# EAGLE board Resistor_Resistor (EAGLE 8.3.0), part 8 of 32
## Placement (x,y rotation side) (continued)
R9178  10K  [0201]  80.21,109.17 0 top
R9179  10K  [0201]  80.21,109.78 0 top
R9180  10K  [0201]  80.21,110.39 0 top
R9181  10K  [0201]  80.21,111 0 top
R9182  10K  [0201]  80.21,111.61 0 top
R9183  10K  [0201]  80.21,112.22 0 top
R9184  10K  [0201]  80.21,112.83 0 top
R9185  10K  [0201]  80.21,113.44 0 top
R9186  10K  [0201]  80.21,114.05 0 top
R9187  10K  [0201]  80.21,114.66 0 top
R9188  10K  [0201]  80.21,115.27 0 top
R9189  10K  [0201]  80.21,115.87 0 top
R9190  10K  [0201]  80.21,116.48 0 top
R9191  10K  [0201]  80.21,117.09 0 top
R9192  10K  [0201]  80.21,117.7 0 top
R9193  10K  [0201]  80.21,118.31 0 top
R9194  10K  [0201]  80.21,118.92 0 top
R9195  10K  [0201]  80.21,119.53 0 top
R9196  10K  [0201]  80.21,120.14 0 top
R9197  10K  [0201]  80.21,120.75 0 top
R9198  10K  [0201]  80.21,121.36 0 top
R9199  10K  [0201]  80.21,121.97 0 top
R9200  10K  [0201]  80.21,122.58 0 top
R9201  10K  [0201]  81.43,1.27 0 top
R9202  10K  [0201]  81.43,1.88 0 top
R9203  10K  [0201]  81.43,2.49 0 top
R9204  10K  [0201]  81.43,3.1 0 top
R9205  10K  [0201]  81.43,3.71 0 top
R9206  10K  [0201]  81.43,4.32 0 top
R9207  10K  [0201]  81.43,4.93 0 top
R9208  10K  [0201]  81.43,5.54 0 top
R9209  10K  [0201]  81.43,6.15 0 top
R9210  10K  [0201]  81.43,6.76 0 top
R9211  10K  [0201]  81.43,7.37 0 top
R9212  10K  [0201]  81.43,7.98 0 top
R9213  10K  [0201]  81.43,8.59 0 top
R9214  10K  [0201]  81.43,9.19 0 top
R9215  10K  [0201]  81.43,9.8 0 top
R9216  10K  [0201]  81.43,10.41 0 top
R9217  10K  [0201]  81.43,11.02 0 top
R9218  10K  [0201]  81.43,11.63 0 top
R9219  10K  [0201]  81.43,12.24 0 top
R9220  10K  [0201]  81.43,12.85 0 top
R9221  10K  [0201]  81.43,13.46 0 top
R9222  10K  [0201]  81.43,14.07 0 top
R9223  10K  [0201]  81.43,14.68 0 top
R9224  10K  [0201]  81.43,15.29 0 top
R9225  10K  [0201]  81.43,15.9 0 top
R9226  10K  [0201]  81.43,16.51 0 top
R9227  10K  [0201]  81.43,17.12 0 top
R9228  10K  [0201]  81.43,17.73 0 top
R9229  10K  [0201]  81.43,18.34 0 top
R9230  10K  [0201]  81.43,18.95 0 top
R9231  10K  [0201]  81.43,19.56 0 top
R9232  10K  [0201]  81.43,20.17 0 top
R9233  10K  [0201]  81.43,20.78 0 top
R9234  10K  [0201]  81.43,21.39 0 top
R9235  10K  [0201]  81.43,22 0 top
R9236  10K  [0201]  81.43,22.61 0 top
R9237  10K  [0201]  81.43,23.22 0 top
R9238  10K  [0201]  81.43,23.83 0 top
R9239  10K  [0201]  81.43,24.43 0 top
R9240  10K  [0201]  81.43,25.04 0 top
R9241  10K  [0201]  81.43,25.65 0 top
R9242  10K  [0201]  81.43,26.26 0 top
R9243  10K  [0201]  81.43,26.87 0 top
R9244  10K  [0201]  81.43,27.48 0 top
R9245  10K  [0201]  81.43,28.09 0 top
R9246  10K  [0201]  81.43,28.7 0 top
R9247  10K  [0201]  81.43,29.31 0 top
R9248  10K  [0201]  81.43,29.92 0 top
R9249  10K  [0201]  81.43,30.53 0 top
R9250  10K  [0201]  81.43,31.14 0 top
R9251  10K  [0201]  81.43,31.75 0 top
R9252  10K  [0201]  81.43,32.36 0 top
R9253  10K  [0201]  81.43,32.97 0 top
R9254  10K  [0201]  81.43,33.58 0 top
R9255  10K  [0201]  81.43,34.19 0 top
R9256  10K  [0201]  81.43,34.8 0 top
R9257  10K  [0201]  81.43,35.41 0 top
R9258  10K  [0201]  81.43,36.02 0 top
R9259  10K  [0201]  81.43,36.63 0 top
R9260  10K  [0201]  81.43,37.24 0 top
R9261  10K  [0201]  81.43,37.85 0 top
R9262  10K  [0201]  81.43,38.46 0 top
R9263  10K  [0201]  81.43,39.07 0 top
R9264  10K  [0201]  81.43,39.67 0 top
R9265  10K  [0201]  81.43,40.28 0 top
R9266  10K  [0201]  81.43,40.89 0 top
R9267  10K  [0201]  81.43,41.5 0 top
R9268  10K  [0201]  81.43,42.11 0 top
R9269  10K  [0201]  81.43,42.72 0 top
R9270  10K  [0201]  81.43,43.33 0 top
R9271  10K  [0201]  81.43,43.94 0 top
R9272  10K  [0201]  81.43,44.55 0 top
R9273  10K  [0201]  81.43,45.16 0 top
R9274  10K  [0201]  81.43,45.77 0 top
R9275  10K  [0201]  81.43,46.38 0 top
R9276  10K  [0201]  81.43,46.99 0 top
R9277  10K  [0201]  81.43,47.6 0 top
R9278  10K  [0201]  81.43,48.21 0 top
R9279  10K  [0201]  81.43,48.82 0 top
R9280  10K  [0201]  81.43,49.43 0 top
R9281  10K  [0201]  81.43,50.04 0 top
R9282  10K  [0201]  81.43,50.65 0 top
R9283  10K  [0201]  81.43,51.26 0 top
R9284  10K  [0201]  81.43,51.87 0 top
R9285  10K  [0201]  81.43,52.48 0 top
R9286  10K  [0201]  81.43,53.09 0 top
R9287  10K  [0201]  81.43,53.7 0 top
R9288  10K  [0201]  81.43,54.31 0 top
R9289  10K  [0201]  81.43,54.91 0 top
R9290  10K  [0201]  81.43,55.52 0 top
R9291  10K  [0201]  81.43,56.13 0 top
R9292  10K  [0201]  81.43,56.74 0 top
R9293  10K  [0201]  81.43,57.35 0 top
R9294  10K  [0201]  81.43,57.96 0 top
R9295  10K  [0201]  81.43,58.57 0 top
R9296  10K  [0201]  81.43,59.18 0 top
R9297  10K  [0201]  81.43,59.79 0 top
R9298  10K  [0201]  81.43,60.4 0 top
R9299  10K  [0201]  81.43,61.01 0 top
R9300  10K  [0201]  81.43,61.62 0 top
R9301  10K  [0201]  81.43,62.23 0 top
R9302  10K  [0201]  81.43,62.84 0 top
R9303  10K  [0201]  81.43,63.45 0 top
R9304  10K  [0201]  81.43,64.06 0 top
R9305  10K  [0201]  81.43,64.67 0 top
R9306  10K  [0201]  81.43,65.28 0 top
R9307  10K  [0201]  81.43,65.89 0 top
R9308  10K  [0201]  81.43,66.5 0 top
R9309  10K  [0201]  81.43,67.11 0 top
R9310  10K  [0201]  81.43,67.72 0 top
R9311  10K  [0201]  81.43,68.33 0 top
R9312  10K  [0201]  81.43,68.94 0 top
R9313  10K  [0201]  81.43,69.55 0 top
R9314  10K  [0201]  81.43,70.15 0 top
R9315  10K  [0201]  81.43,70.76 0 top
R9316  10K  [0201]  81.43,71.37 0 top
R9317  10K  [0201]  81.43,71.98 0 top
R9318  10K  [0201]  81.43,72.59 0 top
R9319  10K  [0201]  81.43,73.2 0 top
R9320  10K  [0201]  81.43,73.81 0 top
R9321  10K  [0201]  81.43,74.42 0 top
R9322  10K  [0201]  81.43,75.03 0 top
R9323  10K  [0201]  81.43,75.64 0 top
R9324  10K  [0201]  81.43,76.25 0 top
R9325  10K  [0201]  81.43,76.86 0 top
R9326  10K  [0201]  81.43,77.47 0 top
R9327  10K  [0201]  81.43,78.08 0 top
R9328  10K  [0201]  81.43,78.69 0 top
R9329  10K  [0201]  81.43,79.3 0 top
R9330  10K  [0201]  81.43,79.91 0 top
R9331  10K  [0201]  81.43,80.52 0 top
R9332  10K  [0201]  81.43,81.13 0 top
R9333  10K  [0201]  81.43,81.74 0 top
R9334  10K  [0201]  81.43,82.35 0 top
R9335  10K  [0201]  81.43,82.96 0 top
R9336  10K  [0201]  81.43,83.57 0 top
R9337  10K  [0201]  81.43,84.18 0 top
R9338  10K  [0201]  81.43,84.79 0 top
R9339  10K  [0201]  81.43,85.39 0 top
R9340  10K  [0201]  81.43,86 0 top
R9341  10K  [0201]  81.43,86.61 0 top
R9342  10K  [0201]  81.43,87.22 0 top
R9343  10K  [0201]  81.43,87.83 0 top
R9344  10K  [0201]  81.43,88.44 0 top
R9345  10K  [0201]  81.43,89.05 0 top
R9346  10K  [0201]  81.43,89.66 0 top
R9347  10K  [0201]  81.43,90.27 0 top
R9348  10K  [0201]  81.43,90.88 0 top
R9349  10K  [0201]  81.43,91.49 0 top
R9350  10K  [0201]  81.43,92.1 0 top
R9351  10K  [0201]  81.43,92.71 0 top
R9352  10K  [0201]  81.43,93.32 0 top
R9353  10K  [0201]  81.43,93.93 0 top
R9354  10K  [0201]  81.43,94.54 0 top
R9355  10K  [0201]  81.43,95.15 0 top
R9356  10K  [0201]  81.43,95.76 0 top
R9357  10K  [0201]  81.43,96.37 0 top
R9358  10K  [0201]  81.43,96.98 0 top
R9359  10K  [0201]  81.43,97.59 0 top
R9360  10K  [0201]  81.43,98.2 0 top
R9361  10K  [0201]  81.43,98.81 0 top
R9362  10K  [0201]  81.43,99.42 0 top
R9363  10K  [0201]  81.43,100.03 0 top
R9364  10K  [0201]  81.43,100.63 0 top
R9365  10K  [0201]  81.43,101.24 0 top
R9366  10K  [0201]  81.43,101.85 0 top
R9367  10K  [0201]  81.43,102.46 0 top
R9368  10K  [0201]  81.43,103.07 0 top
R9369  10K  [0201]  81.43,103.68 0 top
R9370  10K  [0201]  81.43,104.29 0 top
R9371  10K  [0201]  81.43,104.9 0 top
R9372  10K  [0201]  81.43,105.51 0 top
R9373  10K  [0201]  81.43,106.12 0 top
R9374  10K  [0201]  81.43,106.73 0 top
R9375  10K  [0201]  81.43,107.34 0 top
R9376  10K  [0201]  81.43,107.95 0 top
R9377  10K  [0201]  81.43,108.56 0 top
R9378  10K  [0201]  81.43,109.17 0 top
R9379  10K  [0201]  81.43,109.78 0 top
R9380  10K  [0201]  81.43,110.39 0 top
R9381  10K  [0201]  81.43,111 0 top
R9382  10K  [0201]  81.43,111.61 0 top
R9383  10K  [0201]  81.43,112.22 0 top
R9384  10K  [0201]  81.43,112.83 0 top
R9385  10K  [0201]  81.43,113.44 0 top
R9386  10K  [0201]  81.43,114.05 0 top
R9387  10K  [0201]  81.43,114.66 0 top
R9388  10K  [0201]  81.43,115.27 0 top
R9389  10K  [0201]  81.43,115.87 0 top
R9390  10K  [0201]  81.43,116.48 0 top
R9391  10K  [0201]  81.43,117.09 0 top
R9392  10K  [0201]  81.43,117.7 0 top
R9393  10K  [0201]  81.43,118.31 0 top
R9394  10K  [0201]  81.43,118.92 0 top
R9395  10K  [0201]  81.43,119.53 0 top
R9396  10K  [0201]  81.43,120.14 0 top
R9397  10K  [0201]  81.43,120.75 0 top
R9398  10K  [0201]  81.43,121.36 0 top
R9399  10K  [0201]  81.43,121.97 0 top
R9400  10K  [0201]  81.43,122.58 0 top
R9401  10K  [0201]  82.65,1.27 0 top
R9402  10K  [0201]  82.65,1.88 0 top
R9403  10K  [0201]  82.65,2.49 0 top
R9404  10K  [0201]  82.65,3.1 0 top
R9405  10K  [0201]  82.65,3.71 0 top
R9406  10K  [0201]  82.65,4.32 0 top
R9407  10K  [0201]  82.65,4.93 0 top
R9408  10K  [0201]  82.65,5.54 0 top
R9409  10K  [0201]  82.65,6.15 0 top
R9410  10K  [0201]  82.65,6.76 0 top
R9411  10K  [0201]  82.65,7.37 0 top
R9412  10K  [0201]  82.65,7.98 0 top
R9413  10K  [0201]  82.65,8.59 0 top
R9414  10K  [0201]  82.65,9.19 0 top
R9415  10K  [0201]  82.65,9.8 0 top
R9416  10K  [0201]  82.65,10.41 0 top
R9417  10K  [0201]  82.65,11.02 0 top
R9418  10K  [0201]  82.65,11.63 0 top
R9419  10K  [0201]  82.65,12.24 0 top
R9420  10K  [0201]  82.65,12.85 0 top
R9421  10K  [0201]  82.65,13.46 0 top
R9422  10K  [0201]  82.65,14.07 0 top
R9423  10K  [0201]  82.65,14.68 0 top
R9424  10K  [0201]  82.65,15.29 0 top
R9425  10K  [0201]  82.65,15.9 0 top
R9426  10K  [0201]  82.65,16.51 0 top
R9427  10K  [0201]  82.65,17.12 0 top
R9428  10K  [0201]  82.65,17.73 0 top
R9429  10K  [0201]  82.65,18.34 0 top
R9430  10K  [0201]  82.65,18.95 0 top
R9431  10K  [0201]  82.65,19.56 0 top
R9432  10K  [0201]  82.65,20.17 0 top
R9433  10K  [0201]  82.65,20.78 0 top
R9434  10K  [0201]  82.65,21.39 0 top
R9435  10K  [0201]  82.65,22 0 top
R9436  10K  [0201]  82.65,22.61 0 top
R9437  10K  [0201]  82.65,23.22 0 top
R9438  10K  [0201]  82.65,23.83 0 top
R9439  10K  [0201]  82.65,24.43 0 top
R9440  10K  [0201]  82.65,25.04 0 top
R9441  10K  [0201]  82.65,25.65 0 top
R9442  10K  [0201]  82.65,26.26 0 top
R9443  10K  [0201]  82.65,26.87 0 top
R9444  10K  [0201]  82.65,27.48 0 top
R9445  10K  [0201]  82.65,28.09 0 top
R9446  10K  [0201]  82.65,28.7 0 top
R9447  10K  [0201]  82.65,29.31 0 top
R9448  10K  [0201]  82.65,29.92 0 top
R9449  10K  [0201]  82.65,30.53 0 top
R9450  10K  [0201]  82.65,31.14 0 top
R9451  10K  [0201]  82.65,31.75 0 top
R9452  10K  [0201]  82.65,32.36 0 top
R9453  10K  [0201]  82.65,32.97 0 top
R9454  10K  [0201]  82.65,33.58 0 top
R9455  10K  [0201]  82.65,34.19 0 top
R9456  10K  [0201]  82.65,34.8 0 top
R9457  10K  [0201]  82.65,35.41 0 top
R9458  10K  [0201]  82.65,36.02 0 top
R9459  10K  [0201]  82.65,36.63 0 top
R9460  10K  [0201]  82.65,37.24 0 top
R9461  10K  [0201]  82.65,37.85 0 top
R9462  10K  [0201]  82.65,38.46 0 top
R9463  10K  [0201]  82.65,39.07 0 top
R9464  10K  [0201]  82.65,39.67 0 top
R9465  10K  [0201]  82.65,40.28 0 top
R9466  10K  [0201]  82.65,40.89 0 top
R9467  10K  [0201]  82.65,41.5 0 top
R9468  10K  [0201]  82.65,42.11 0 top
R9469  10K  [0201]  82.65,42.72 0 top
R9470  10K  [0201]  82.65,43.33 0 top
R9471  10K  [0201]  82.65,43.94 0 top
R9472  10K  [0201]  82.65,44.55 0 top
R9473  10K  [0201]  82.65,45.16 0 top
R9474  10K  [0201]  82.65,45.77 0 top
R9475  10K  [0201]  82.65,46.38 0 top
R9476  10K  [0201]  82.65,46.99 0 top
R9477  10K  [0201]  82.65,47.6 0 top
R9478  10K  [0201]  82.65,48.21 0 top
R9479  10K  [0201]  82.65,48.82 0 top
R9480  10K  [0201]  82.65,49.43 0 top
R9481  10K  [0201]  82.65,50.04 0 top
R9482  10K  [0201]  82.65,50.65 0 top
R9483  10K  [0201]  82.65,51.26 0 top
R9484  10K  [0201]  82.65,51.87 0 top
R9485  10K  [0201]  82.65,52.48 0 top
R9486  10K  [0201]  82.65,53.09 0 top
R9487  10K  [0201]  82.65,53.7 0 top
R9488  10K  [0201]  82.65,54.31 0 top
R9489  10K  [0201]  82.65,54.91 0 top
R9490  10K  [0201]  82.65,55.52 0 top
R9491  10K  [0201]  82.65,56.13 0 top
R9492  10K  [0201]  82.65,56.74 0 top
R9493  10K  [0201]  82.65,57.35 0 top
R9494  10K  [0201]  82.65,57.96 0 top
R9495  10K  [0201]  82.65,58.57 0 top
R9496  10K  [0201]  82.65,59.18 0 top
R9497  10K  [0201]  82.65,59.79 0 top
R9498  10K  [0201]  82.65,60.4 0 top
R9499  10K  [0201]  82.65,61.01 0 top
R9500  10K  [0201]  82.65,61.62 0 top
R9501  10K  [0201]  82.65,62.23 0 top
R9502  10K  [0201]  82.65,62.84 0 top
R9503  10K  [0201]  82.65,63.45 0 top
R9504  10K  [0201]  82.65,64.06 0 top
R9505  10K  [0201]  82.65,64.67 0 top
R9506  10K  [0201]  82.65,65.28 0 top
R9507  10K  [0201]  82.65,65.89 0 top
R9508  10K  [0201]  82.65,66.5 0 top
R9509  10K  [0201]  82.65,67.11 0 top
R9510  10K  [0201]  82.65,67.72 0 top
R9511  10K  [0201]  82.65,68.33 0 top
R9512  10K  [0201]  82.65,68.94 0 top
R9513  10K  [0201]  82.65,69.55 0 top
R9514  10K  [0201]  82.65,70.15 0 top
R9515  10K  [0201]  82.65,70.76 0 top
R9516  10K  [0201]  82.65,71.37 0 top
R9517  10K  [0201]  82.65,71.98 0 top
R9518  10K  [0201]  82.65,72.59 0 top
R9519  10K  [0201]  82.65,73.2 0 top
R9520  10K  [0201]  82.65,73.81 0 top
R9521  10K  [0201]  82.65,74.42 0 top
R9522  10K  [0201]  82.65,75.03 0 top
R9523  10K  [0201]  82.65,75.64 0 top
R9524  10K  [0201]  82.65,76.25 0 top
R9525  10K  [0201]  82.65,76.86 0 top
R9526  10K  [0201]  82.65,77.47 0 top
R9527  10K  [0201]  82.65,78.08 0 top
R9528  10K  [0201]  82.65,78.69 0 top
R9529  10K  [0201]  82.65,79.3 0 top
R9530  10K  [0201]  82.65,79.91 0 top
R9531  10K  [0201]  82.65,80.52 0 top
R9532  10K  [0201]  82.65,81.13 0 top
R9533  10K  [0201]  82.65,81.74 0 top
R9534  10K  [0201]  82.65,82.35 0 top
R9535  10K  [0201]  82.65,82.96 0 top
R9536  10K  [0201]  82.65,83.57 0 top
R9537  10K  [0201]  82.65,84.18 0 top
R9538  10K  [0201]  82.65,84.79 0 top
R9539  10K  [0201]  82.65,85.39 0 top
R9540  10K  [0201]  82.65,86 0 top
R9541  10K  [0201]  82.65,86.61 0 top
R9542  10K  [0201]  82.65,87.22 0 top
R9543  10K  [0201]  82.65,87.83 0 top
R9544  10K  [0201]  82.65,88.44 0 top
R9545  10K  [0201]  82.65,89.05 0 top
R9546  10K  [0201]  82.65,89.66 0 top
R9547  10K  [0201]  82.65,90.27 0 top
R9548  10K  [0201]  82.65,90.88 0 top
R9549  10K  [0201]  82.65,91.49 0 top
R9550  10K  [0201]  82.65,92.1 0 top
R9551  10K  [0201]  82.65,92.71 0 top
R9552  10K  [0201]  82.65,93.32 0 top
R9553  10K  [0201]  82.65,93.93 0 top
R9554  10K  [0201]  82.65,94.54 0 top
R9555  10K  [0201]  82.65,95.15 0 top
R9556  10K  [0201]  82.65,95.76 0 top
R9557  10K  [0201]  82.65,96.37 0 top
R9558  10K  [0201]  82.65,96.98 0 top
R9559  10K  [0201]  82.65,97.59 0 top
R9560  10K  [0201]  82.65,98.2 0 top
R9561  10K  [0201]  82.65,98.81 0 top
R9562  10K  [0201]  82.65,99.42 0 top
R9563  10K  [0201]  82.65,100.03 0 top
R9564  10K  [0201]  82.65,100.63 0 top
R9565  10K  [0201]  82.65,101.24 0 top
R9566  10K  [0201]  82.65,101.85 0 top
R9567  10K  [0201]  82.65,102.46 0 top
R9568  10K  [0201]  82.65,103.07 0 top
R9569  10K  [0201]  82.65,103.68 0 top
R9570  10K  [0201]  82.65,104.29 0 top
R9571  10K  [0201]  82.65,104.9 0 top
R9572  10K  [0201]  82.65,105.51 0 top
R9573  10K  [0201]  82.65,106.12 0 top
R9574  10K  [0201]  82.65,106.73 0 top
R9575  10K  [0201]  82.65,107.34 0 top
R9576  10K  [0201]  82.65,107.95 0 top
R9577  10K  [0201]  82.65,108.56 0 top
R9578  10K  [0201]  82.65,109.17 0 top
R9579  10K  [0201]  82.65,109.78 0 top
R9580  10K  [0201]  82.65,110.39 0 top
R9581  10K  [0201]  82.65,111 0 top
R9582  10K  [0201]  82.65,111.61 0 top
R9583  10K  [0201]  82.65,112.22 0 top
R9584  10K  [0201]  82.65,112.83 0 top
R9585  10K  [0201]  82.65,113.44 0 top
R9586  10K  [0201]  82.65,114.05 0 top
R9587  10K  [0201]  82.65,114.66 0 top
R9588  10K  [0201]  82.65,115.27 0 top
R9589  10K  [0201]  82.65,115.87 0 top
R9590  10K  [0201]  82.65,116.48 0 top
R9591  10K  [0201]  82.65,117.09 0 top
R9592  10K  [0201]  82.65,117.7 0 top
R9593  10K  [0201]  82.65,118.31 0 top
R9594  10K  [0201]  82.65,118.92 0 top
R9595  10K  [0201]  82.65,119.53 0 top
R9596  10K  [0201]  82.65,120.14 0 top
R9597  10K  [0201]  82.65,120.75 0 top
R9598  10K  [0201]  82.65,121.36 0 top
R9599  10K  [0201]  82.65,121.97 0 top
R9600  10K  [0201]  82.65,122.58 0 top
R9601  10K  [0201]  83.87,1.27 0 top
R9602  10K  [0201]  83.87,1.88 0 top
R9603  10K  [0201]  83.87,2.49 0 top
R9604  10K  [0201]  83.87,3.1 0 top
R9605  10K  [0201]  83.87,3.71 0 top
R9606  10K  [0201]  83.87,4.32 0 top
R9607  10K  [0201]  83.87,4.93 0 top
R9608  10K  [0201]  83.87,5.54 0 top
R9609  10K  [0201]  83.87,6.15 0 top
R9610  10K  [0201]  83.87,6.76 0 top
R9611  10K  [0201]  83.87,7.37 0 top
R9612  10K  [0201]  83.87,7.98 0 top
R9613  10K  [0201]  83.87,8.59 0 top
R9614  10K  [0201]  83.87,9.19 0 top
R9615  10K  [0201]  83.87,9.8 0 top
R9616  10K  [0201]  83.87,10.41 0 top
R9617  10K  [0201]  83.87,11.02 0 top
R9618  10K  [0201]  83.87,11.63 0 top
R9619  10K  [0201]  83.87,12.24 0 top
R9620  10K  [0201]  83.87,12.85 0 top
R9621  10K  [0201]  83.87,13.46 0 top
R9622  10K  [0201]  83.87,14.07 0 top
R9623  10K  [0201]  83.87,14.68 0 top
R9624  10K  [0201]  83.87,15.29 0 top
R9625  10K  [0201]  83.87,15.9 0 top
R9626  10K  [0201]  83.87,16.51 0 top
R9627  10K  [0201]  83.87,17.12 0 top
R9628  10K  [0201]  83.87,17.73 0 top
R9629  10K  [0201]  83.87,18.34 0 top
R9630  10K  [0201]  83.87,18.95 0 top
R9631  10K  [0201]  83.87,19.56 0 top
R9632  10K  [0201]  83.87,20.17 0 top
R9633  10K  [0201]  83.87,20.78 0 top
R9634  10K  [0201]  83.87,21.39 0 top
R9635  10K  [0201]  83.87,22 0 top
R9636  10K  [0201]  83.87,22.61 0 top
R9637  10K  [0201]  83.87,23.22 0 top
R9638  10K  [0201]  83.87,23.83 0 top
R9639  10K  [0201]  83.87,24.43 0 top
R9640  10K  [0201]  83.87,25.04 0 top
R9641  10K  [0201]  83.87,25.65 0 top
R9642  10K  [0201]  83.87,26.26 0 top
R9643  10K  [0201]  83.87,26.87 0 top
R9644  10K  [0201]  83.87,27.48 0 top
R9645  10K  [0201]  83.87,28.09 0 top
R9646  10K  [0201]  83.87,28.7 0 top
R9647  10K  [0201]  83.87,29.31 0 top
R9648  10K  [0201]  83.87,29.92 0 top
R9649  10K  [0201]  83.87,30.53 0 top
R9650  10K  [0201]  83.87,31.14 0 top
R9651  10K  [0201]  83.87,31.75 0 top
R9652  10K  [0201]  83.87,32.36 0 top
R9653  10K  [0201]  83.87,32.97 0 top
R9654  10K  [0201]  83.87,33.58 0 top
R9655  10K  [0201]  83.87,34.19 0 top
R9656  10K  [0201]  83.87,34.8 0 top
R9657  10K  [0201]  83.87,35.41 0 top
R9658  10K  [0201]  83.87,36.02 0 top
R9659  10K  [0201]  83.87,36.63 0 top
R9660  10K  [0201]  83.87,37.24 0 top
R9661  10K  [0201]  83.87,37.85 0 top
R9662  10K  [0201]  83.87,38.46 0 top
R9663  10K  [0201]  83.87,39.07 0 top
R9664  10K  [0201]  83.87,39.67 0 top
R9665  10K  [0201]  83.87,40.28 0 top
R9666  10K  [0201]  83.87,40.89 0 top
R9667  10K  [0201]  83.87,41.5 0 top
R9668  10K  [0201]  83.87,42.11 0 top
R9669  10K  [0201]  83.87,42.72 0 top
R9670  10K  [0201]  83.87,43.33 0 top
R9671  10K  [0201]  83.87,43.94 0 top
R9672  10K  [0201]  83.87,44.55 0 top
R9673  10K  [0201]  83.87,45.16 0 top
R9674  10K  [0201]  83.87,45.77 0 top
R9675  10K  [0201]  83.87,46.38 0 top
R9676  10K  [0201]  83.87,46.99 0 top
R9677  10K  [0201]  83.87,47.6 0 top
R9678  10K  [0201]  83.87,48.21 0 top
R9679  10K  [0201]  83.87,48.82 0 top
R9680  10K  [0201]  83.87,49.43 0 top
R9681  10K  [0201]  83.87,50.04 0 top
R9682  10K  [0201]  83.87,50.65 0 top
R9683  10K  [0201]  83.87,51.26 0 top
R9684  10K  [0201]  83.87,51.87 0 top
R9685  10K  [0201]  83.87,52.48 0 top
R9686  10K  [0201]  83.87,53.09 0 top
R9687  10K  [0201]  83.87,53.7 0 top
R9688  10K  [0201]  83.87,54.31 0 top
R9689  10K  [0201]  83.87,54.91 0 top
R9690  10K  [0201]  83.87,55.52 0 top
R9691  10K  [0201]  83.87,56.13 0 top
R9692  10K  [0201]  83.87,56.74 0 top
R9693  10K  [0201]  83.87,57.35 0 top
R9694  10K  [0201]  83.87,57.96 0 top
R9695  10K  [0201]  83.87,58.57 0 top
R9696  10K  [0201]  83.87,59.18 0 top
R9697  10K  [0201]  83.87,59.79 0 top
R9698  10K  [0201]  83.87,60.4 0 top
R9699  10K  [0201]  83.87,61.01 0 top
R9700  10K  [0201]  83.87,61.62 0 top
R9701  10K  [0201]  83.87,62.23 0 top
R9702  10K  [0201]  83.87,62.84 0 top
R9703  10K  [0201]  83.87,63.45 0 top
R9704  10K  [0201]  83.87,64.06 0 top
R9705  10K  [0201]  83.87,64.67 0 top
R9706  10K  [0201]  83.87,65.28 0 top
R9707  10K  [0201]  83.87,65.89 0 top
R9708  10K  [0201]  83.87,66.5 0 top
R9709  10K  [0201]  83.87,67.11 0 top
R9710  10K  [0201]  83.87,67.72 0 top
R9711  10K  [0201]  83.87,68.33 0 top
R9712  10K  [0201]  83.87,68.94 0 top
R9713  10K  [0201]  83.87,69.55 0 top
R9714  10K  [0201]  83.87,70.15 0 top
R9715  10K  [0201]  83.87,70.76 0 top
R9716  10K  [0201]  83.87,71.37 0 top
R9717  10K  [0201]  83.87,71.98 0 top
R9718  10K  [0201]  83.87,72.59 0 top
R9719  10K  [0201]  83.87,73.2 0 top
R9720  10K  [0201]  83.87,73.81 0 top
R9721  10K  [0201]  83.87,74.42 0 top
R9722  10K  [0201]  83.87,75.03 0 top
R9723  10K  [0201]  83.87,75.64 0 top
R9724  10K  [0201]  83.87,76.25 0 top
R9725  10K  [0201]  83.87,76.86 0 top
R9726  10K  [0201]  83.87,77.47 0 top
R9727  10K  [0201]  83.87,78.08 0 top
R9728  10K  [0201]  83.87,78.69 0 top
R9729  10K  [0201]  83.87,79.3 0 top
R9730  10K  [0201]  83.87,79.91 0 top
R9731  10K  [0201]  83.87,80.52 0 top
R9732  10K  [0201]  83.87,81.13 0 top
R9733  10K  [0201]  83.87,81.74 0 top
R9734  10K  [0201]  83.87,82.35 0 top
R9735  10K  [0201]  83.87,82.96 0 top
R9736  10K  [0201]  83.87,83.57 0 top
R9737  10K  [0201]  83.87,84.18 0 top
R9738  10K  [0201]  83.87,84.79 0 top
R9739  10K  [0201]  83.87,85.39 0 top
R9740  10K  [0201]  83.87,86 0 top
R9741  10K  [0201]  83.87,86.61 0 top
R9742  10K  [0201]  83.87,87.22 0 top
R9743  10K  [0201]  83.87,87.83 0 top
R9744  10K  [0201]  83.87,88.44 0 top
R9745  10K  [0201]  83.87,89.05 0 top
R9746  10K  [0201]  83.87,89.66 0 top
R9747  10K  [0201]  83.87,90.27 0 top
R9748  10K  [0201]  83.87,90.88 0 top
R9749  10K  [0201]  83.87,91.49 0 top
R9750  10K  [0201]  83.87,92.1 0 top
R9751  10K  [0201]  83.87,92.71 0 top
R9752  10K  [0201]  83.87,93.32 0 top
R9753  10K  [0201]  83.87,93.93 0 top
R9754  10K  [0201]  83.87,94.54 0 top
R9755  10K  [0201]  83.87,95.15 0 top
R9756  10K  [0201]  83.87,95.76 0 top
R9757  10K  [0201]  83.87,96.37 0 top
R9758  10K  [0201]  83.87,96.98 0 top
R9759  10K  [0201]  83.87,97.59 0 top
R9760  10K  [0201]  83.87,98.2 0 top
R9761  10K  [0201]  83.87,98.81 0 top
R9762  10K  [0201]  83.87,99.42 0 top
R9763  10K  [0201]  83.87,100.03 0 top
R9764  10K  [0201]  83.87,100.63 0 top
R9765  10K  [0201]  83.87,101.24 0 top
R9766  10K  [0201]  83.87,101.85 0 top
R9767  10K  [0201]  83.87,102.46 0 top
R9768  10K  [0201]  83.87,103.07 0 top
R9769  10K  [0201]  83.87,103.68 0 top
R9770  10K  [0201]  83.87,104.29 0 top
R9771  10K  [0201]  83.87,104.9 0 top
R9772  10K  [0201]  83.87,105.51 0 top
R9773  10K  [0201]  83.87,106.12 0 top
R9774  10K  [0201]  83.87,106.73 0 top
R9775  10K  [0201]  83.87,107.34 0 top
R9776  10K  [0201]  83.87,107.95 0 top
R9777  10K  [0201]  83.87,108.56 0 top
R9778  10K  [0201]  83.87,109.17 0 top
R9779  10K  [0201]  83.87,109.78 0 top
R9780  10K  [0201]  83.87,110.39 0 top
R9781  10K  [0201]  83.87,111 0 top
R9782  10K  [0201]  83.87,111.61 0 top
R9783  10K  [0201]  83.87,112.22 0 top
R9784  10K  [0201]  83.87,112.83 0 top
R9785  10K  [0201]  83.87,113.44 0 top
R9786  10K  [0201]  83.87,114.05 0 top
R9787  10K  [0201]  83.87,114.66 0 top
R9788  10K  [0201]  83.87,115.27 0 top
R9789  10K  [0201]  83.87,115.87 0 top
R9790  10K  [0201]  83.87,116.48 0 top
R9791  10K  [0201]  83.87,117.09 0 top
R9792  10K  [0201]  83.87,117.7 0 top
R9793  10K  [0201]  83.87,118.31 0 top
R9794  10K  [0201]  83.87,118.92 0 top
R9795  10K  [0201]  83.87,119.53 0 top
R9796  10K  [0201]  83.87,120.14 0 top
R9797  10K  [0201]  83.87,120.75 0 top
R9798  10K  [0201]  83.87,121.36 0 top
R9799  10K  [0201]  83.87,121.97 0 top
R9800  10K  [0201]  83.87,122.58 0 top
R9801  10K  [0201]  85.09,1.27 0 top
R9802  10K  [0201]  85.09,1.88 0 top
R9803  10K  [0201]  85.09,2.49 0 top
R9804  10K  [0201]  85.09,3.1 0 top
R9805  10K  [0201]  85.09,3.71 0 top
R9806  10K  [0201]  85.09,4.32 0 top
R9807  10K  [0201]  85.09,4.93 0 top
R9808  10K  [0201]  85.09,5.54 0 top
R9809  10K  [0201]  85.09,6.15 0 top
R9810  10K  [0201]  85.09,6.76 0 top
R9811  10K  [0201]  85.09,7.37 0 top
R9812  10K  [0201]  85.09,7.98 0 top
R9813  10K  [0201]  85.09,8.59 0 top
R9814  10K  [0201]  85.09,9.19 0 top
R9815  10K  [0201]  85.09,9.8 0 top
R9816  10K  [0201]  85.09,10.41 0 top
R9817  10K  [0201]  85.09,11.02 0 top
R9818  10K  [0201]  85.09,11.63 0 top
R9819  10K  [0201]  85.09,12.24 0 top
R9820  10K  [0201]  85.09,12.85 0 top
R9821  10K  [0201]  85.09,13.46 0 top
R9822  10K  [0201]  85.09,14.07 0 top
R9823  10K  [0201]  85.09,14.68 0 top
R9824  10K  [0201]  85.09,15.29 0 top
R9825  10K  [0201]  85.09,15.9 0 top
R9826  10K  [0201]  85.09,16.51 0 top
R9827  10K  [0201]  85.09,17.12 0 top
R9828  10K  [0201]  85.09,17.73 0 top
R9829  10K  [0201]  85.09,18.34 0 top
R9830  10K  [0201]  85.09,18.95 0 top
R9831  10K  [0201]  85.09,19.56 0 top
R9832  10K  [0201]  85.09,20.17 0 top
R9833  10K  [0201]  85.09,20.78 0 top
R9834  10K  [0201]  85.09,21.39 0 top
R9835  10K  [0201]  85.09,22 0 top
R9836  10K  [0201]  85.09,22.61 0 top
R9837  10K  [0201]  85.09,23.22 0 top
R9838  10K  [0201]  85.09,23.83 0 top
R9839  10K  [0201]  85.09,24.43 0 top
R9840  10K  [0201]  85.09,25.04 0 top
R9841  10K  [0201]  85.09,25.65 0 top
R9842  10K  [0201]  85.09,26.26 0 top
R9843  10K  [0201]  85.09,26.87 0 top
R9844  10K  [0201]  85.09,27.48 0 top
R9845  10K  [0201]  85.09,28.09 0 top
R9846  10K  [0201]  85.09,28.7 0 top
R9847  10K  [0201]  85.09,29.31 0 top
R9848  10K  [0201]  85.09,29.92 0 top
R9849  10K  [0201]  85.09,30.53 0 top
R9850  10K  [0201]  85.09,31.14 0 top
R9851  10K  [0201]  85.09,31.75 0 top
R9852  10K  [0201]  85.09,32.36 0 top
R9853  10K  [0201]  85.09,32.97 0 top
R9854  10K  [0201]  85.09,33.58 0 top
R9855  10K  [0201]  85.09,34.19 0 top
R9856  10K  [0201]  85.09,34.8 0 top
R9857  10K  [0201]  85.09,35.41 0 top
R9858  10K  [0201]  85.09,36.02 0 top
R9859  10K  [0201]  85.09,36.63 0 top
R9860  10K  [0201]  85.09,37.24 0 top
R9861  10K  [0201]  85.09,37.85 0 top
R9862  10K  [0201]  85.09,38.46 0 top
R9863  10K  [0201]  85.09,39.07 0 top
R9864  10K  [0201]  85.09,39.67 0 top
R9865  10K  [0201]  85.09,40.28 0 top
R9866  10K  [0201]  85.09,40.89 0 top
R9867  10K  [0201]  85.09,41.5 0 top
R9868  10K  [0201]  85.09,42.11 0 top
R9869  10K  [0201]  85.09,42.72 0 top
R9870  10K  [0201]  85.09,43.33 0 top
R9871  10K  [0201]  85.09,43.94 0 top
R9872  10K  [0201]  85.09,44.55 0 top
R9873  10K  [0201]  85.09,45.16 0 top
R9874  10K  [0201]  85.09,45.77 0 top
R9875  10K  [0201]  85.09,46.38 0 top
R9876  10K  [0201]  85.09,46.99 0 top
R9877  10K  [0201]  85.09,47.6 0 top
R9878  10K  [0201]  85.09,48.21 0 top
R9879  10K  [0201]  85.09,48.82 0 top
R9880  10K  [0201]  85.09,49.43 0 top
R9881  10K  [0201]  85.09,50.04 0 top
R9882  10K  [0201]  85.09,50.65 0 top
R9883  10K  [0201]  85.09,51.26 0 top
R9884  10K  [0201]  85.09,51.87 0 top
R9885  10K  [0201]  85.09,52.48 0 top
R9886  10K  [0201]  85.09,53.09 0 top
R9887  10K  [0201]  85.09,53.7 0 top
R9888  10K  [0201]  85.09,54.31 0 top
R9889  10K  [0201]  85.09,54.91 0 top
R9890  10K  [0201]  85.09,55.52 0 top
R9891  10K  [0201]  85.09,56.13 0 top
R9892  10K  [0201]  85.09,56.74 0 top
R9893  10K  [0201]  85.09,57.35 0 top
R9894  10K  [0201]  85.09,57.96 0 top
R9895  10K  [0201]  85.09,58.57 0 top
R9896  10K  [0201]  85.09,59.18 0 top
R9897  10K  [0201]  85.09,59.79 0 top
R9898  10K  [0201]  85.09,60.4 0 top
R9899  10K  [0201]  85.09,61.01 0 top
R9900  10K  [0201]  85.09,61.62 0 top
R9901  10K  [0201]  85.09,62.23 0 top
R9902  10K  [0201]  85.09,62.84 0 top
R9903  10K  [0201]  85.09,63.45 0 top
R9904  10K  [0201]  85.09,64.06 0 top
R9905  10K  [0201]  85.09,64.67 0 top
R9906  10K  [0201]  85.09,65.28 0 top
R9907  10K  [0201]  85.09,65.89 0 top
R9908  10K  [0201]  85.09,66.5 0 top
R9909  10K  [0201]  85.09,67.11 0 top
R9910  10K  [0201]  85.09,67.72 0 top
R9911  10K  [0201]  85.09,68.33 0 top
R9912  10K  [0201]  85.09,68.94 0 top
R9913  10K  [0201]  85.09,69.55 0 top
R9914  10K  [0201]  85.09,70.15 0 top
R9915  10K  [0201]  85.09,70.76 0 top
R9916  10K  [0201]  85.09,71.37 0 top
R9917  10K  [0201]  85.09,71.98 0 top
R9918  10K  [0201]  85.09,72.59 0 top
R9919  10K  [0201]  85.09,73.2 0 top
R9920  10K  [0201]  85.09,73.81 0 top
R9921  10K  [0201]  85.09,74.42 0 top
R9922  10K  [0201]  85.09,75.03 0 top
R9923  10K  [0201]  85.09,75.64 0 top
R9924  10K  [0201]  85.09,76.25 0 top
R9925  10K  [0201]  85.09,76.86 0 top
R9926  10K  [0201]  85.09,77.47 0 top
R9927  10K  [0201]  85.09,78.08 0 top
R9928  10K  [0201]  85.09,78.69 0 top
R9929  10K  [0201]  85.09,79.3 0 top
R9930  10K  [0201]  85.09,79.91 0 top
R9931  10K  [0201]  85.09,80.52 0 top
R9932  10K  [0201]  85.09,81.13 0 top
R9933  10K  [0201]  85.09,81.74 0 top
R9934  10K  [0201]  85.09,82.35 0 top
R9935  10K  [0201]  85.09,82.96 0 top
R9936  10K  [0201]  85.09,83.57 0 top
R9937  10K  [0201]  85.09,84.18 0 top
R9938  10K  [0201]  85.09,84.79 0 top
R9939  10K  [0201]  85.09,85.39 0 top
R9940  10K  [0201]  85.09,86 0 top
R9941  10K  [0201]  85.09,86.61 0 top
R9942  10K  [0201]  85.09,87.22 0 top
R9943  10K  [0201]  85.09,87.83 0 top
R9944  10K  [0201]  85.09,88.44 0 top
R9945  10K  [0201]  85.09,89.05 0 top
R9946  10K  [0201]  85.09,89.66 0 top
R9947  10K  [0201]  85.09,90.27 0 top
R9948  10K  [0201]  85.09,90.88 0 top
R9949  10K  [0201]  85.09,91.49 0 top
R9950  10K  [0201]  85.09,92.1 0 top
R9951  10K  [0201]  85.09,92.71 0 top
R9952  10K  [0201]  85.09,93.32 0 top
R9953  10K  [0201]  85.09,93.93 0 top
R9954  10K  [0201]  85.09,94.54 0 top
R9955  10K  [0201]  85.09,95.15 0 top
R9956  10K  [0201]  85.09,95.76 0 top
R9957  10K  [0201]  85.09,96.37 0 top
R9958  10K  [0201]  85.09,96.98 0 top
R9959  10K  [0201]  85.09,97.59 0 top
R9960  10K  [0201]  85.09,98.2 0 top
R9961  10K  [0201]  85.09,98.81 0 top
R9962  10K  [0201]  85.09,99.42 0 top
R9963  10K  [0201]  85.09,100.03 0 top
R9964  10K  [0201]  85.09,100.63 0 top
R9965  10K  [0201]  85.09,101.24 0 top
R9966  10K  [0201]  85.09,101.85 0 top
R9967  10K  [0201]  85.09,102.46 0 top
R9968  10K  [0201]  85.09,103.07 0 top
R9969  10K  [0201]  85.09,103.68 0 top
R9970  10K  [0201]  85.09,104.29 0 top
R9971  10K  [0201]  85.09,104.9 0 top
R9972  10K  [0201]  85.09,105.51 0 top
R9973  10K  [0201]  85.09,106.12 0 top
R9974  10K  [0201]  85.09,106.73 0 top
R9975  10K  [0201]  85.09,107.34 0 top
R9976  10K  [0201]  85.09,107.95 0 top
R9977  10K  [0201]  85.09,108.56 0 top
R9978  10K  [0201]  85.09,109.17 0 top
R9979  10K  [0201]  85.09,109.78 0 top
R9980  10K  [0201]  85.09,110.39 0 top
R9981  10K  [0201]  85.09,111 0 top
R9982  10K  [0201]  85.09,111.61 0 top
R9983  10K  [0201]  85.09,112.22 0 top
R9984  10K  [0201]  85.09,112.83 0 top
R9985  10K  [0201]  85.09,113.44 0 top
R9986  10K  [0201]  85.09,114.05 0 top
R9987  10K  [0201]  85.09,114.66 0 top
R9988  10K  [0201]  85.09,115.27 0 top
R9989  10K  [0201]  85.09,115.87 0 top
R9990  10K  [0201]  85.09,116.48 0 top
R9991  10K  [0201]  85.09,117.09 0 top
R9992  10K  [0201]  85.09,117.7 0 top
R9993  10K  [0201]  85.09,118.31 0 top
R9994  10K  [0201]  85.09,118.92 0 top
R9995  10K  [0201]  85.09,119.53 0 top
R9996  10K  [0201]  85.09,120.14 0 top
R9997  10K  [0201]  85.09,120.75 0 top
R9998  10K  [0201]  85.09,121.36 0 top
R9999  10K  [0201]  85.09,121.97 0 top
R10000  10K  [0201]  85.09,122.58 0 top
R10001  10K  [0201]  86.31,1.27 0 top
R10002  10K  [0201]  86.31,1.88 0 top
R10003  10K  [0201]  86.31,2.49 0 top
R10004  10K  [0201]  86.31,3.1 0 top
R10005  10K  [0201]  86.31,3.71 0 top
R10006  10K  [0201]  86.31,4.32 0 top
R10007  10K  [0201]  86.31,4.93 0 top
R10008  10K  [0201]  86.31,5.54 0 top
R10009  10K  [0201]  86.31,6.15 0 top
R10010  10K  [0201]  86.31,6.76 0 top
R10011  10K  [0201]  86.31,7.37 0 top
R10012  10K  [0201]  86.31,7.98 0 top
R10013  10K  [0201]  86.31,8.59 0 top
R10014  10K  [0201]  86.31,9.19 0 top
R10015  10K  [0201]  86.31,9.8 0 top
R10016  10K  [0201]  86.31,10.41 0 top
R10017  10K  [0201]  86.31,11.02 0 top
R10018  10K  [0201]  86.31,11.63 0 top
R10019  10K  [0201]  86.31,12.24 0 top
R10020  10K  [0201]  86.31,12.85 0 top
R10021  10K  [0201]  86.31,13.46 0 top
R10022  10K  [0201]  86.31,14.07 0 top
R10023  10K  [0201]  86.31,14.68 0 top
R10024  10K  [0201]  86.31,15.29 0 top
R10025  10K  [0201]  86.31,15.9 0 top
R10026  10K  [0201]  86.31,16.51 0 top
R10027  10K  [0201]  86.31,17.12 0 top
R10028  10K  [0201]  86.31,17.73 0 top
R10029  10K  [0201]  86.31,18.34 0 top
R10030  10K  [0201]  86.31,18.95 0 top
R10031  10K  [0201]  86.31,19.56 0 top
R10032  10K  [0201]  86.31,20.17 0 top
R10033  10K  [0201]  86.31,20.78 0 top
R10034  10K  [0201]  86.31,21.39 0 top
R10035  10K  [0201]  86.31,22 0 top
R10036  10K  [0201]  86.31,22.61 0 top
R10037  10K  [0201]  86.31,23.22 0 top
R10038  10K  [0201]  86.31,23.83 0 top
R10039  10K  [0201]  86.31,24.43 0 top
R10040  10K  [0201]  86.31,25.04 0 top
R10041  10K  [0201]  86.31,25.65 0 top
R10042  10K  [0201]  86.31,26.26 0 top
R10043  10K  [0201]  86.31,26.87 0 top
R10044  10K  [0201]  86.31,27.48 0 top
R10045  10K  [0201]  86.31,28.09 0 top
R10046  10K  [0201]  86.31,28.7 0 top
R10047  10K  [0201]  86.31,29.31 0 top
R10048  10K  [0201]  86.31,29.92 0 top
R10049  10K  [0201]  86.31,30.53 0 top
R10050  10K  [0201]  86.31,31.14 0 top
R10051  10K  [0201]  86.31,31.75 0 top
R10052  10K  [0201]  86.31,32.36 0 top
R10053  10K  [0201]  86.31,32.97 0 top
R10054  10K  [0201]  86.31,33.58 0 top
R10055  10K  [0201]  86.31,34.19 0 top
R10056  10K  [0201]  86.31,34.8 0 top
R10057  10K  [0201]  86.31,35.41 0 top
R10058  10K  [0201]  86.31,36.02 0 top
R10059  10K  [0201]  86.31,36.63 0 top
R10060  10K  [0201]  86.31,37.24 0 top
R10061  10K  [0201]  86.31,37.85 0 top
R10062  10K  [0201]  86.31,38.46 0 top
R10063  10K  [0201]  86.31,39.07 0 top
R10064  10K  [0201]  86.31,39.67 0 top
R10065  10K  [0201]  86.31,40.28 0 top
R10066  10K  [0201]  86.31,40.89 0 top
R10067  10K  [0201]  86.31,41.5 0 top
R10068  10K  [0201]  86.31,42.11 0 top
R10069  10K  [0201]  86.31,42.72 0 top
R10070  10K  [0201]  86.31,43.33 0 top
R10071  10K  [0201]  86.31,43.94 0 top
R10072  10K  [0201]  86.31,44.55 0 top
R10073  10K  [0201]  86.31,45.16 0 top
R10074  10K  [0201]  86.31,45.77 0 top
R10075  10K  [0201]  86.31,46.38 0 top
R10076  10K  [0201]  86.31,46.99 0 top
R10077  10K  [0201]  86.31,47.6 0 top
R10078  10K  [0201]  86.31,48.21 0 top
R10079  10K  [0201]  86.31,48.82 0 top
R10080  10K  [0201]  86.31,49.43 0 top
R10081  10K  [0201]  86.31,50.04 0 top
R10082  10K  [0201]  86.31,50.65 0 top
R10083  10K  [0201]  86.31,51.26 0 top
R10084  10K  [0201]  86.31,51.87 0 top
R10085  10K  [0201]  86.31,52.48 0 top
R10086  10K  [0201]  86.31,53.09 0 top
R10087  10K  [0201]  86.31,53.7 0 top
R10088  10K  [0201]  86.31,54.31 0 top
R10089  10K  [0201]  86.31,54.91 0 top
R10090  10K  [0201]  86.31,55.52 0 top
R10091  10K  [0201]  86.31,56.13 0 top
R10092  10K  [0201]  86.31,56.74 0 top
R10093  10K  [0201]  86.31,57.35 0 top
R10094  10K  [0201]  86.31,57.96 0 top
R10095  10K  [0201]  86.31,58.57 0 top
R10096  10K  [0201]  86.31,59.18 0 top
R10097  10K  [0201]  86.31,59.79 0 top
R10098  10K  [0201]  86.31,60.4 0 top
R10099  10K  [0201]  86.31,61.01 0 top
R10100  10K  [0201]  86.31,61.62 0 top
R10101  10K  [0201]  86.31,62.23 0 top
R10102  10K  [0201]  86.31,62.84 0 top
R10103  10K  [0201]  86.31,63.45 0 top
R10104  10K  [0201]  86.31,64.06 0 top
R10105  10K  [0201]  86.31,64.67 0 top
R10106  10K  [0201]  86.31,65.28 0 top
R10107  10K  [0201]  86.31,65.89 0 top
R10108  10K  [0201]  86.31,66.5 0 top
R10109  10K  [0201]  86.31,67.11 0 top
R10110  10K  [0201]  86.31,67.72 0 top
R10111  10K  [0201]  86.31,68.33 0 top
R10112  10K  [0201]  86.31,68.94 0 top
R10113  10K  [0201]  86.31,69.55 0 top
R10114  10K  [0201]  86.31,70.15 0 top
R10115  10K  [0201]  86.31,70.76 0 top
R10116  10K  [0201]  86.31,71.37 0 top
R10117  10K  [0201]  86.31,71.98 0 top
R10118  10K  [0201]  86.31,72.59 0 top
R10119  10K  [0201]  86.31,73.2 0 top
R10120  10K  [0201]  86.31,73.81 0 top
R10121  10K  [0201]  86.31,74.42 0 top
R10122  10K  [0201]  86.31,75.03 0 top
R10123  10K  [0201]  86.31,75.64 0 top
R10124  10K  [0201]  86.31,76.25 0 top
R10125  10K  [0201]  86.31,76.86 0 top
R10126  10K  [0201]  86.31,77.47 0 top
R10127  10K  [0201]  86.31,78.08 0 top
R10128  10K  [0201]  86.31,78.69 0 top
R10129  10K  [0201]  86.31,79.3 0 top
R10130  10K  [0201]  86.31,79.91 0 top
R10131  10K  [0201]  86.31,80.52 0 top
R10132  10K  [0201]  86.31,81.13 0 top
R10133  10K  [0201]  86.31,81.74 0 top
R10134  10K  [0201]  86.31,82.35 0 top
R10135  10K  [0201]  86.31,82.96 0 top
R10136  10K  [0201]  86.31,83.57 0 top
R10137  10K  [0201]  86.31,84.18 0 top
R10138  10K  [0201]  86.31,84.79 0 top
R10139  10K  [0201]  86.31,85.39 0 top
R10140  10K  [0201]  86.31,86 0 top
R10141  10K  [0201]  86.31,86.61 0 top
R10142  10K  [0201]  86.31,87.22 0 top
R10143  10K  [0201]  86.31,87.83 0 top
R10144  10K  [0201]  86.31,88.44 0 top
R10145  10K  [0201]  86.31,89.05 0 top
R10146  10K  [0201]  86.31,89.66 0 top
R10147  10K  [0201]  86.31,90.27 0 top
R10148  10K  [0201]  86.31,90.88 0 top
R10149  10K  [0201]  86.31,91.49 0 top
R10150  10K  [0201]  86.31,92.1 0 top
R10151  10K  [0201]  86.31,92.71 0 top
R10152  10K  [0201]  86.31,93.32 0 top
R10153  10K  [0201]  86.31,93.93 0 top
R10154  10K  [0201]  86.31,94.54 0 top
R10155  10K  [0201]  86.31,95.15 0 top
R10156  10K  [0201]  86.31,95.76 0 top
R10157  10K  [0201]  86.31,96.37 0 top
R10158  10K  [0201]  86.31,96.98 0 top
R10159  10K  [0201]  86.31,97.59 0 top
R10160  10K  [0201]  86.31,98.2 0 top
R10161  10K  [0201]  86.31,98.81 0 top
R10162  10K  [0201]  86.31,99.42 0 top
R10163  10K  [0201]  86.31,100.03 0 top
R10164  10K  [0201]  86.31,100.63 0 top
R10165  10K  [0201]  86.31,101.24 0 top
R10166  10K  [0201]  86.31,101.85 0 top
R10167  10K  [0201]  86.31,102.46 0 top
R10168  10K  [0201]  86.31,103.07 0 top
R10169  10K  [0201]  86.31,103.68 0 top
R10170  10K  [0201]  86.31,104.29 0 top
R10171  10K  [0201]  86.31,104.9 0 top
R10172  10K  [0201]  86.31,105.51 0 top
R10173  10K  [0201]  86.31,106.12 0 top
R10174  10K  [0201]  86.31,106.73 0 top
R10175  10K  [0201]  86.31,107.34 0 top
R10176  10K  [0201]  86.31,107.95 0 top
R10177  10K  [0201]  86.31,108.56 0 top
R10178  10K  [0201]  86.31,109.17 0 top
R10179  10K  [0201]  86.31,109.78 0 top
R10180  10K  [0201]  86.31,110.39 0 top
R10181  10K  [0201]  86.31,111 0 top
R10182  10K  [0201]  86.31,111.61 0 top
R10183  10K  [0201]  86.31,112.22 0 top
R10184  10K  [0201]  86.31,112.83 0 top
R10185  10K  [0201]  86.31,113.44 0 top
R10186  10K  [0201]  86.31,114.05 0 top
R10187  10K  [0201]  86.31,114.66 0 top
R10188  10K  [0201]  86.31,115.27 0 top
R10189  10K  [0201]  86.31,115.87 0 top
R10190  10K  [0201]  86.31,116.48 0 top
R10191  10K  [0201]  86.31,117.09 0 top
R10192  10K  [0201]  86.31,117.7 0 top
R10193  10K  [0201]  86.31,118.31 0 top
R10194  10K  [0201]  86.31,118.92 0 top
R10195  10K  [0201]  86.31,119.53 0 top
R10196  10K  [0201]  86.31,120.14 0 top
R10197  10K  [0201]  86.31,120.75 0 top
R10198  10K  [0201]  86.31,121.36 0 top
R10199  10K  [0201]  86.31,121.97 0 top
R10200  10K  [0201]  86.31,122.58 0 top
R10201  10K  [0201]  87.53,1.27 0 top
R10202  10K  [0201]  87.53,1.88 0 top
R10203  10K  [0201]  87.53,2.49 0 top
R10204  10K  [0201]  87.53,3.1 0 top
R10205  10K  [0201]  87.53,3.71 0 top
R10206  10K  [0201]  87.53,4.32 0 top
R10207  10K  [0201]  87.53,4.93 0 top
R10208  10K  [0201]  87.53,5.54 0 top
R10209  10K  [0201]  87.53,6.15 0 top
R10210  10K  [0201]  87.53,6.76 0 top
R10211  10K  [0201]  87.53,7.37 0 top
R10212  10K  [0201]  87.53,7.98 0 top
R10213  10K  [0201]  87.53,8.59 0 top
R10214  10K  [0201]  87.53,9.19 0 top
R10215  10K  [0201]  87.53,9.8 0 top
R10216  10K  [0201]  87.53,10.41 0 top
R10217  10K  [0201]  87.53,11.02 0 top
R10218  10K  [0201]  87.53,11.63 0 top
R10219  10K  [0201]  87.53,12.24 0 top
R10220  10K  [0201]  87.53,12.85 0 top
R10221  10K  [0201]  87.53,13.46 0 top
R10222  10K  [0201]  87.53,14.07 0 top
R10223  10K  [0201]  87.53,14.68 0 top
R10224  10K  [0201]  87.53,15.29 0 top
R10225  10K  [0201]  87.53,15.9 0 top
R10226  10K  [0201]  87.53,16.51 0 top
R10227  10K  [0201]  87.53,17.12 0 top
R10228  10K  [0201]  87.53,17.73 0 top
R10229  10K  [0201]  87.53,18.34 0 top
R10230  10K  [0201]  87.53,18.95 0 top
R10231  10K  [0201]  87.53,19.56 0 top
R10232  10K  [0201]  87.53,20.17 0 top
R10233  10K  [0201]  87.53,20.78 0 top
R10234  10K  [0201]  87.53,21.39 0 top
R10235  10K  [0201]  87.53,22 0 top
R10236  10K  [0201]  87.53,22.61 0 top
R10237  10K  [0201]  87.53,23.22 0 top
R10238  10K  [0201]  87.53,23.83 0 top
R10239  10K  [0201]  87.53,24.43 0 top
R10240  10K  [0201]  87.53,25.04 0 top
R10241  10K  [0201]  87.53,25.65 0 top
R10242  10K  [0201]  87.53,26.26 0 top
R10243  10K  [0201]  87.53,26.87 0 top
R10244  10K  [0201]  87.53,27.48 0 top
R10245  10K  [0201]  87.53,28.09 0 top
R10246  10K  [0201]  87.53,28.7 0 top
R10247  10K  [0201]  87.53,29.31 0 top
R10248  10K  [0201]  87.53,29.92 0 top
R10249  10K  [0201]  87.53,30.53 0 top
R10250  10K  [0201]  87.53,31.14 0 top
R10251  10K  [0201]  87.53,31.75 0 top
R10252  10K  [0201]  87.53,32.36 0 top
R10253  10K  [0201]  87.53,32.97 0 top
R10254  10K  [0201]  87.53,33.58 0 top
R10255  10K  [0201]  87.53,34.19 0 top
R10256  10K  [0201]  87.53,34.8 0 top
R10257  10K  [0201]  87.53,35.41 0 top
R10258  10K  [0201]  87.53,36.02 0 top
R10259  10K  [0201]  87.53,36.63 0 top
R10260  10K  [0201]  87.53,37.24 0 top
R10261  10K  [0201]  87.53,37.85 0 top
R10262  10K  [0201]  87.53,38.46 0 top
R10263  10K  [0201]  87.53,39.07 0 top
R10264  10K  [0201]  87.53,39.67 0 top
R10265  10K  [0201]  87.53,40.28 0 top
R10266  10K  [0201]  87.53,40.89 0 top
R10267  10K  [0201]  87.53,41.5 0 top
R10268  10K  [0201]  87.53,42.11 0 top
R10269  10K  [0201]  87.53,42.72 0 top
R10270  10K  [0201]  87.53,43.33 0 top
R10271  10K  [0201]  87.53,43.94 0 top
R10272  10K  [0201]  87.53,44.55 0 top
R10273  10K  [0201]  87.53,45.16 0 top
R10274  10K  [0201]  87.53,45.77 0 top
R10275  10K  [0201]  87.53,46.38 0 top
R10276  10K  [0201]  87.53,46.99 0 top
R10277  10K  [0201]  87.53,47.6 0 top
R10278  10K  [0201]  87.53,48.21 0 top
R10279  10K  [0201]  87.53,48.82 0 top
R10280  10K  [0201]  87.53,49.43 0 top
R10281  10K  [0201]  87.53,50.04 0 top
R10282  10K  [0201]  87.53,50.65 0 top
R10283  10K  [0201]  87.53,51.26 0 top
R10284  10K  [0201]  87.53,51.87 0 top
R10285  10K  [0201]  87.53,52.48 0 top
R10286  10K  [0201]  87.53,53.09 0 top
R10287  10K  [0201]  87.53,53.7 0 top
R10288  10K  [0201]  87.53,54.31 0 top
R10289  10K  [0201]  87.53,54.91 0 top
R10290  10K  [0201]  87.53,55.52 0 top
R10291  10K  [0201]  87.53,56.13 0 top
R10292  10K  [0201]  87.53,56.74 0 top
R10293  10K  [0201]  87.53,57.35 0 top
R10294  10K  [0201]  87.53,57.96 0 top
R10295  10K  [0201]  87.53,58.57 0 top
R10296  10K  [0201]  87.53,59.18 0 top
R10297  10K  [0201]  87.53,59.79 0 top
R10298  10K  [0201]  87.53,60.4 0 top
R10299  10K  [0201]  87.53,61.01 0 top
R10300  10K  [0201]  87.53,61.62 0 top
R10301  10K  [0201]  87.53,62.23 0 top
R10302  10K  [0201]  87.53,62.84 0 top
R10303  10K  [0201]  87.53,63.45 0 top
R10304  10K  [0201]  87.53,64.06 0 top
R10305  10K  [0201]  87.53,64.67 0 top
R10306  10K  [0201]  87.53,65.28 0 top
R10307  10K  [0201]  87.53,65.89 0 top
R10308  10K  [0201]  87.53,66.5 0 top
R10309  10K  [0201]  87.53,67.11 0 top
R10310  10K  [0201]  87.53,67.72 0 top
R10311  10K  [0201]  87.53,68.33 0 top
R10312  10K  [0201]  87.53,68.94 0 top
R10313  10K  [0201]  87.53,69.55 0 top
R10314  10K  [0201]  87.53,70.15 0 top
R10315  10K  [0201]  87.53,70.76 0 top
R10316  10K  [0201]  87.53,71.37 0 top
R10317  10K  [0201]  87.53,71.98 0 top
R10318  10K  [0201]  87.53,72.59 0 top
R10319  10K  [0201]  87.53,73.2 0 top
R10320  10K  [0201]  87.53,73.81 0 top
R10321  10K  [0201]  87.53,74.42 0 top
R10322  10K  [0201]  87.53,75.03 0 top
R10323  10K  [0201]  87.53,75.64 0 top
R10324  10K  [0201]  87.53,76.25 0 top
R10325  10K  [0201]  87.53,76.86 0 top
R10326  10K  [0201]  87.53,77.47 0 top
R10327  10K  [0201]  87.53,78.08 0 top
R10328  10K  [0201]  87.53,78.69 0 top
R10329  10K  [0201]  87.53,79.3 0 top
R10330  10K  [0201]  87.53,79.91 0 top
R10331  10K  [0201]  87.53,80.52 0 top
R10332  10K  [0201]  87.53,81.13 0 top
R10333  10K  [0201]  87.53,81.74 0 top
R10334  10K  [0201]  87.53,82.35 0 top
R10335  10K  [0201]  87.53,82.96 0 top
R10336  10K  [0201]  87.53,83.57 0 top
R10337  10K  [0201]  87.53,84.18 0 top
R10338  10K  [0201]  87.53,84.79 0 top
R10339  10K  [0201]  87.53,85.39 0 top
R10340  10K  [0201]  87.53,86 0 top
R10341  10K  [0201]  87.53,86.61 0 top
R10342  10K  [0201]  87.53,87.22 0 top
R10343  10K  [0201]  87.53,87.83 0 top
R10344  10K  [0201]  87.53,88.44 0 top
R10345  10K  [0201]  87.53,89.05 0 top
R10346  10K  [0201]  87.53,89.66 0 top
R10347  10K  [0201]  87.53,90.27 0 top
R10348  10K  [0201]  87.53,90.88 0 top
R10349  10K  [0201]  87.53,91.49 0 top
R10350  10K  [0201]  87.53,92.1 0 top
R10351  10K  [0201]  87.53,92.71 0 top
R10352  10K  [0201]  87.53,93.32 0 top
R10353  10K  [0201]  87.53,93.93 0 top
R10354  10K  [0201]  87.53,94.54 0 top
R10355  10K  [0201]  87.53,95.15 0 top
R10356  10K  [0201]  87.53,95.76 0 top
R10357  10K  [0201]  87.53,96.37 0 top
R10358  10K  [0201]  87.53,96.98 0 top
R10359  10K  [0201]  87.53,97.59 0 top
R10360  10K  [0201]  87.53,98.2 0 top
R10361  10K  [0201]  87.53,98.81 0 top
R10362  10K  [0201]  87.53,99.42 0 top
R10363  10K  [0201]  87.53,100.03 0 top
R10364  10K  [0201]  87.53,100.63 0 top
R10365  10K  [0201]  87.53,101.24 0 top
R10366  10K  [0201]  87.53,101.85 0 top
R10367  10K  [0201]  87.53,102.46 0 top
R10368  10K  [0201]  87.53,103.07 0 top
R10369  10K  [0201]  87.53,103.68 0 top
R10370  10K  [0201]  87.53,104.29 0 top
R10371  10K  [0201]  87.53,104.9 0 top
R10372  10K  [0201]  87.53,105.51 0 top
R10373  10K  [0201]  87.53,106.12 0 top
R10374  10K  [0201]  87.53,106.73 0 top
R10375  10K  [0201]  87.53,107.34 0 top
R10376  10K  [0201]  87.53,107.95 0 top
R10377  10K  [0201]  87.53,108.56 0 top
R10378  10K  [0201]  87.53,109.17 0 top
R10379  10K  [0201]  87.53,109.78 0 top
R10380  10K  [0201]  87.53,110.39 0 top
R10381  10K  [0201]  87.53,111 0 top
R10382  10K  [0201]  87.53,111.61 0 top
R10383  10K  [0201]  87.53,112.22 0 top
R10384  10K  [0201]  87.53,112.83 0 top
R10385  10K  [0201]  87.53,113.44 0 top
R10386  10K  [0201]  87.53,114.05 0 top
R10387  10K  [0201]  87.53,114.66 0 top
R10388  10K  [0201]  87.53,115.27 0 top
R10389  10K  [0201]  87.53,115.87 0 top
R10390  10K  [0201]  87.53,116.48 0 top
R10391  10K  [0201]  87.53,117.09 0 top
R10392  10K  [0201]  87.53,117.7 0 top
R10393  10K  [0201]  87.53,118.31 0 top
R10394  10K  [0201]  87.53,118.92 0 top
R10395  10K  [0201]  87.53,119.53 0 top
R10396  10K  [0201]  87.53,120.14 0 top
R10397  10K  [0201]  87.53,120.75 0 top
R10398  10K  [0201]  87.53,121.36 0 top
R10399  10K  [0201]  87.53,121.97 0 top
R10400  10K  [0201]  87.53,122.58 0 top
R10401  10K  [0201]  88.75,1.27 0 top
R10402  10K  [0201]  88.75,1.88 0 top
R10403  10K  [0201]  88.75,2.49 0 top
R10404  10K  [0201]  88.75,3.1 0 top
R10405  10K  [0201]  88.75,3.71 0 top
R10406  10K  [0201]  88.75,4.32 0 top
R10407  10K  [0201]  88.75,4.93 0 top
R10408  10K  [0201]  88.75,5.54 0 top
R10409  10K  [0201]  88.75,6.15 0 top
R10410  10K  [0201]  88.75,6.76 0 top
R10411  10K  [0201]  88.75,7.37 0 top
R10412  10K  [0201]  88.75,7.98 0 top
R10413  10K  [0201]  88.75,8.59 0 top
R10414  10K  [0201]  88.75,9.19 0 top
R10415  10K  [0201]  88.75,9.8 0 top
R10416  10K  [0201]  88.75,10.41 0 top
R10417  10K  [0201]  88.75,11.02 0 top
R10418  10K  [0201]  88.75,11.63 0 top
R10419  10K  [0201]  88.75,12.24 0 top
R10420  10K  [0201]  88.75,12.85 0 top
R10421  10K  [0201]  88.75,13.46 0 top
R10422  10K  [0201]  88.75,14.07 0 top
R10423  10K  [0201]  88.75,14.68 0 top
R10424  10K  [0201]  88.75,15.29 0 top
R10425  10K  [0201]  88.75,15.9 0 top
R10426  10K  [0201]  88.75,16.51 0 top
R10427  10K  [0201]  88.75,17.12 0 top
R10428  10K  [0201]  88.75,17.73 0 top
R10429  10K  [0201]  88.75,18.34 0 top
R10430  10K  [0201]  88.75,18.95 0 top
R10431  10K  [0201]  88.75,19.56 0 top
R10432  10K  [0201]  88.75,20.17 0 top
R10433  10K  [0201]  88.75,20.78 0 top
R10434  10K  [0201]  88.75,21.39 0 top
R10435  10K  [0201]  88.75,22 0 top
R10436  10K  [0201]  88.75,22.61 0 top
R10437  10K  [0201]  88.75,23.22 0 top
R10438  10K  [0201]  88.75,23.83 0 top
R10439  10K  [0201]  88.75,24.43 0 top
R10440  10K  [0201]  88.75,25.04 0 top
R10441  10K  [0201]  88.75,25.65 0 top
R10442  10K  [0201]  88.75,26.26 0 top
R10443  10K  [0201]  88.75,26.87 0 top
R10444  10K  [0201]  88.75,27.48 0 top
R10445  10K  [0201]  88.75,28.09 0 top
R10446  10K  [0201]  88.75,28.7 0 top
R10447  10K  [0201]  88.75,29.31 0 top
R10448  10K  [0201]  88.75,29.92 0 top
R10449  10K  [0201]  88.75,30.53 0 top
R10450  10K  [0201]  88.75,31.14 0 top
R10451  10K  [0201]  88.75,31.75 0 top
R10452  10K  [0201]  88.75,32.36 0 top
R10453  10K  [0201]  88.75,32.97 0 top
R10454  10K  [0201]  88.75,33.58 0 top
R10455  10K  [0201]  88.75,34.19 0 top
R10456  10K  [0201]  88.75,34.8 0 top
R10457  10K  [0201]  88.75,35.41 0 top
R10458  10K  [0201]  88.75,36.02 0 top
R10459  10K  [0201]  88.75,36.63 0 top
R10460  10K  [0201]  88.75,37.24 0 top
R10461  10K  [0201]  88.75,37.85 0 top
R10462  10K  [0201]  88.75,38.46 0 top
R10463  10K  [0201]  88.75,39.07 0 top
R10464  10K  [0201]  88.75,39.67 0 top
R10465  10K  [0201]  88.75,40.28 0 top
R10466  10K  [0201]  88.75,40.89 0 top
R10467  10K  [0201]  88.75,41.5 0 top
R10468  10K  [0201]  88.75,42.11 0 top
R10469  10K  [0201]  88.75,42.72 0 top
R10470  10K  [0201]  88.75,43.33 0 top
R10471  10K  [0201]  88.75,43.94 0 top
R10472  10K  [0201]  88.75,44.55 0 top